# EasyEDA Pro project ProPrj_Avaota A1 八核 AIoT 开发板_2024-05-20.epro, board PCB1 (continued)
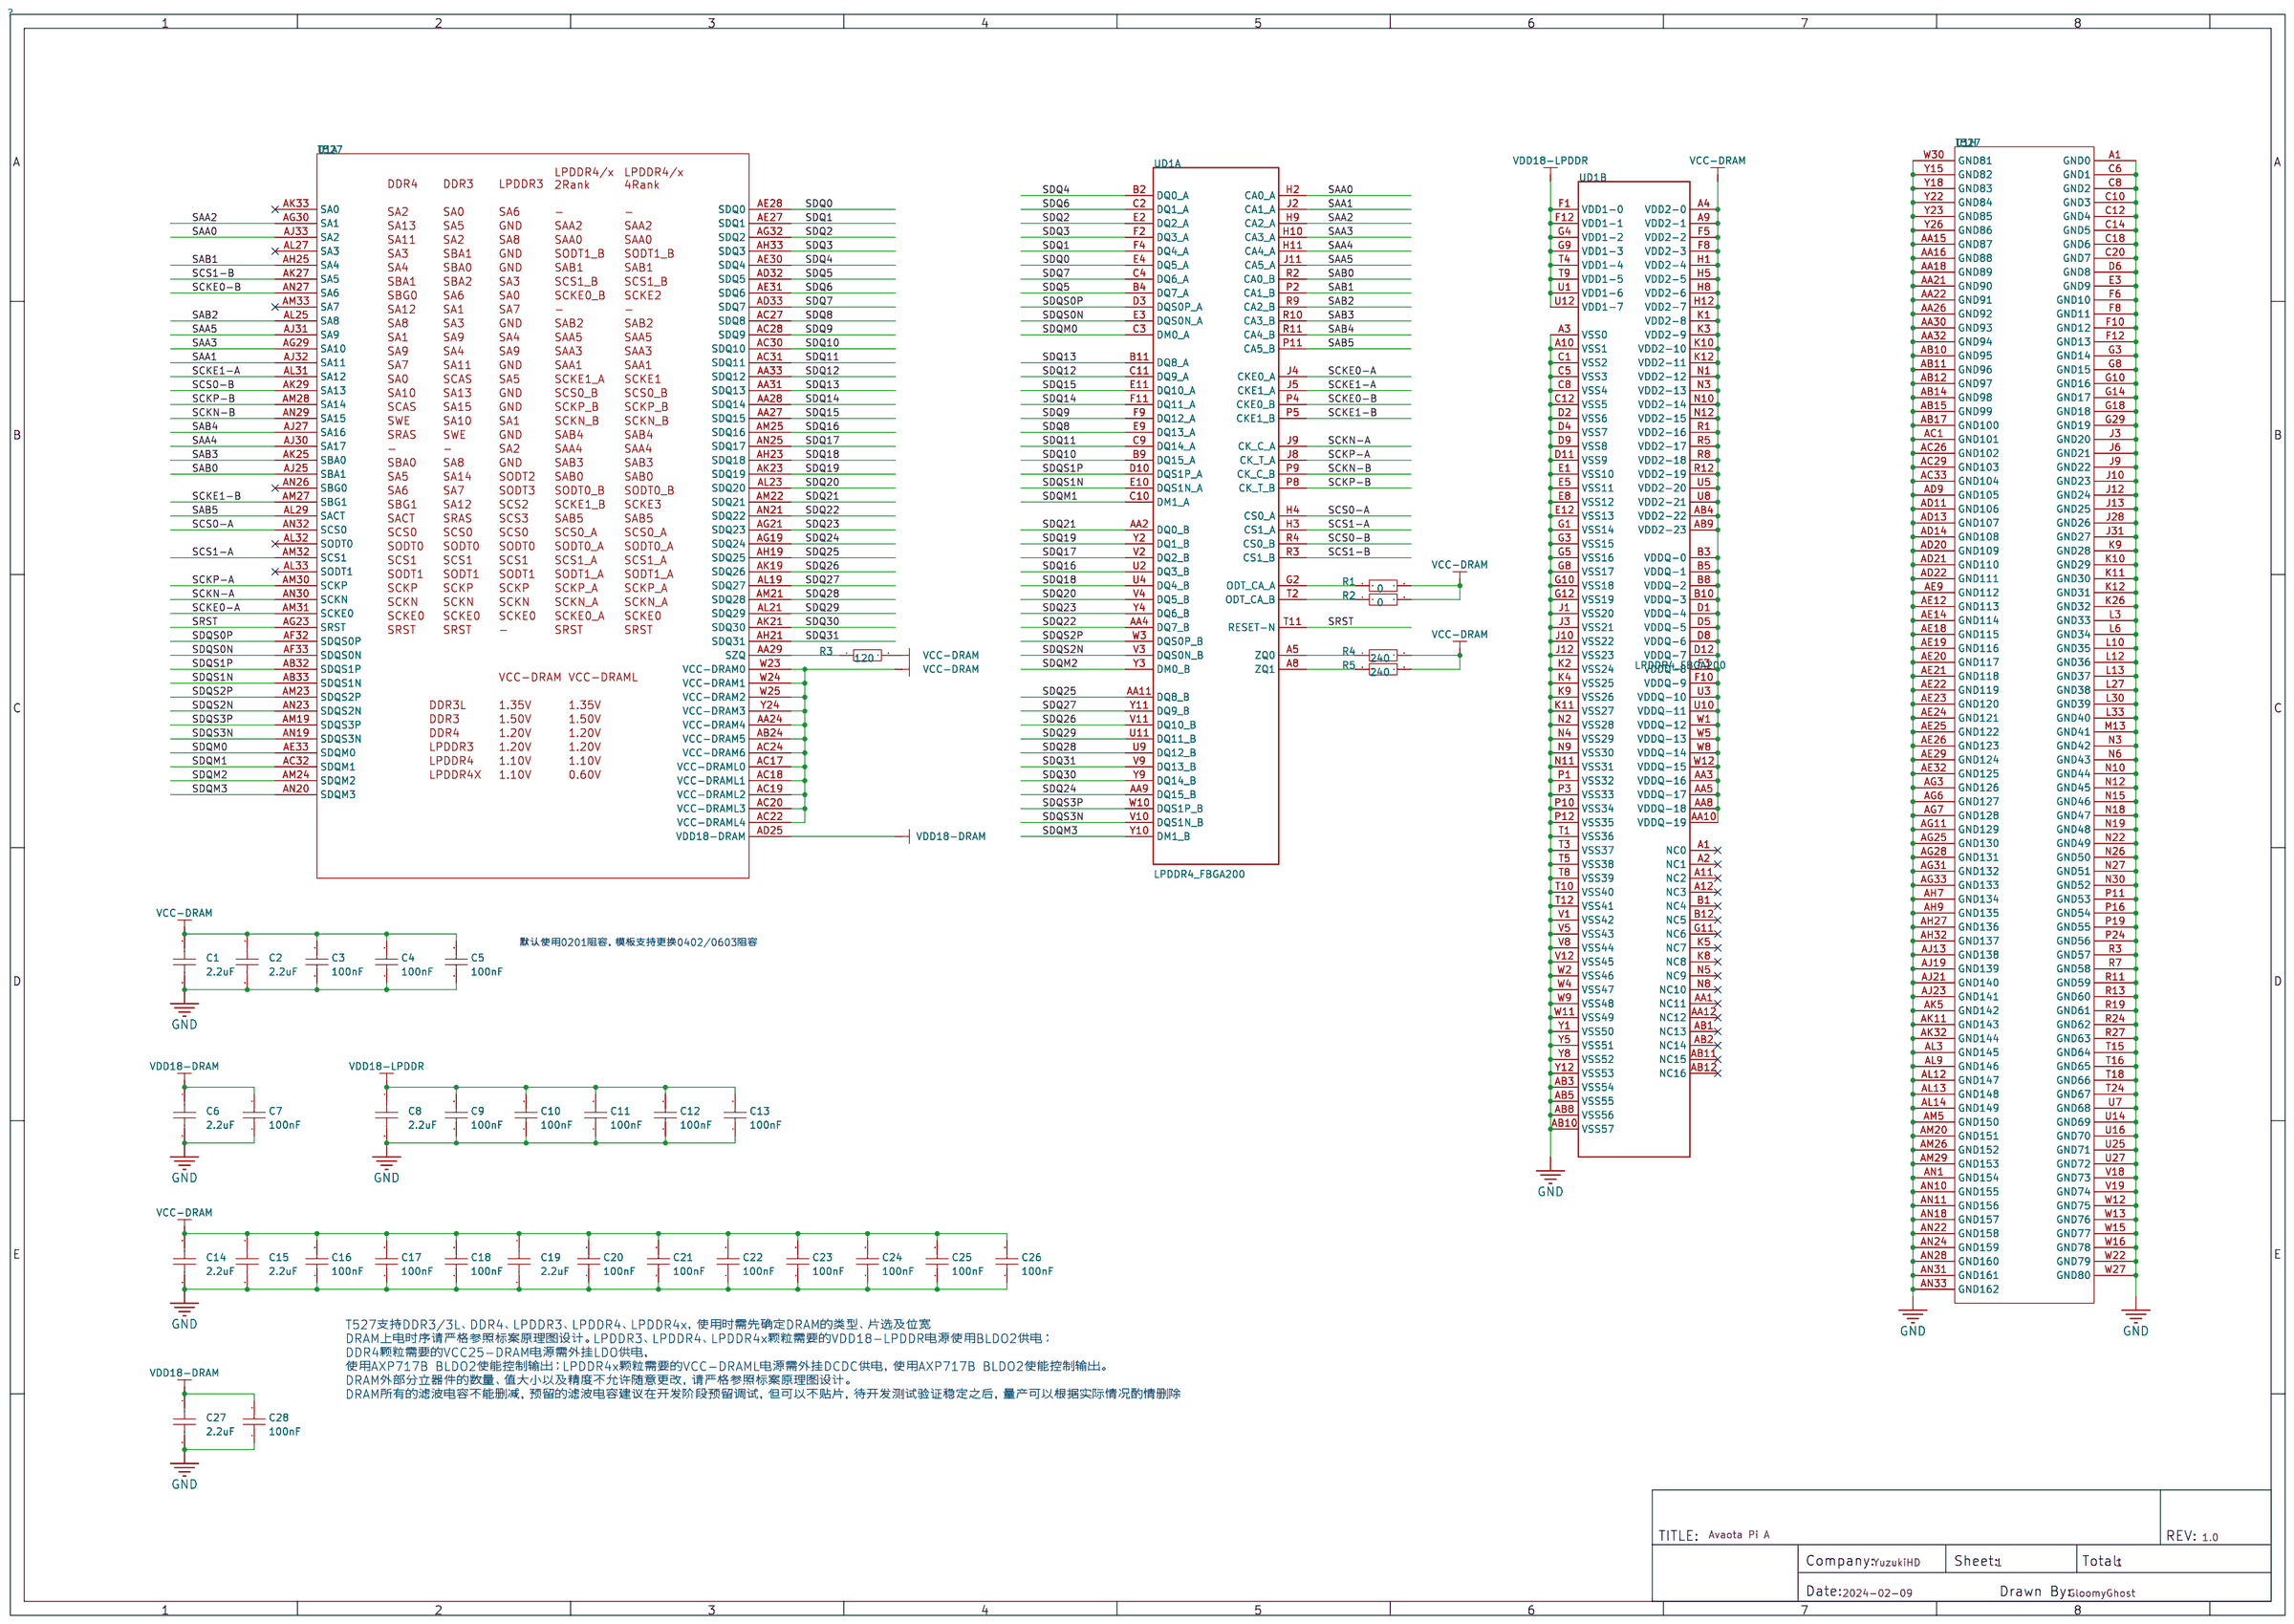
[diagram p0: schematic sheet]
## Routing (per net, layer and track width the routed paths; a pad name or vN(x,y) marks a point on that pad's centre or on a via; arc(x,y) is an arc through that point) (continued)
UART1-RTS: length 57.3
  Top Layer w0.076: U9.44 17.04,66.04 17.5,65.58 17.7,65.58 18.34,64.95 18.34,62.28 17.51,61.45 17.51,61.16 17.73,60.93 18.75,60.93 v3(19.05,61.24)
  Top Layer w0.102: v3(62.95,54.65) U14.R4
  Inner5 w0.102: v3(62.95,54.65) 62.95,54.93 62.36,55.52 61.19,55.52 58.32,58.39 56.69,58.39 55.32,59.77 49.3,59.77 45.34,63.73 21.54,63.73 v3(19.05,61.24)
UART1-RX: length 56.7
  Top Layer w0.076: U9.42 19.05,66.16 19.05,61.85 v3(18.49,61.29)
  Top Layer w0.102: v3(62.95,54.15) U14.R5
  Inner5 w0.102: v3(18.49,61.29) 21.26,64.06 45.44,64.06 49.35,60.15 55.35,60.15 56.82,58.67 58.45,58.67 61.32,55.8 62.59,55.8 63.3,55.09 63.3,54.49 v3(62.95,54.15)
UART1-TX: length 58.8
  Top Layer w0.076: v3(17.91,61.32) 18.72,62.13 18.72,65.08 17.94,65.86 U9.43
  Top Layer w0.102: U14.R6 v3(62.95,53.65)
  Inner5 w0.102: v3(17.91,61.32) 20.98,64.39 45.54,64.39 49.5,60.43 55.52,60.43 57.02,58.93 58.6,58.93 61.42,56.11 62.71,56.11 63.6,55.22 63.6,54.3 v3(62.95,53.65)
USB0-DM: length 37.7
  Top Layer w0.076: U14.B24 69.05,44.65 69.29,44.4 70.72,44.4 70.82,44.5 71.37,44.5 71.45,44.58 75.11,44.58 v3(75.23,44.45)
  Top Layer w0.127: USB3.B7 86.4,67.58 v3(86.33,67.51) ; v3(85.37,65.02) 85.55,65.2 85.55,66.28 D26.2 85.1,66.86 85.34,67.11 v3(85.34,67.49) 85.47,67.62 85.47,68.48 USB3.A7
  VCC w0.127: v3(75.23,44.45) 75.23,44.79 75.37,44.93 75.37,46.84 81.36,52.83 81.36,59.44 85.55,63.63 85.55,64.85 v3(85.37,65.02)
  Bottom Layer w0.127: v3(86.33,67.51) 86.31,67.49 v3(85.34,67.49)
USB0-DP: length 38.1
  Top Layer w0.076: U14.A24 69.66,44.65 69.7,44.6 70.61,44.6 70.69,44.68 71.17,44.68 71.33,44.84 75.43,44.84 v3(75.74,44.53)
  Top Layer w0.127: v3(85.95,65.02) 85.78,65.2 85.78,66.41 D25.2 85.83,67.27 85.83,68.48 USB3.A6 85.9,69.35 85.72,69.52 85.09,69.52 84.9,69.33 USB3.B6
  VCC w0.127: v3(75.74,44.53) 75.74,44.79 75.6,44.93 75.6,46.7 81.64,52.73 81.64,59.36 85.78,63.5 85.78,64.85 v3(85.95,65.02)
USB0-DRVVBUS: length 90
  Top Layer w0.076: 56.92,47.11 v1(56.92,46.99) 56.87,47.22 56.67,47.32 56.46,47.57 55.01,47.57 U14.AL17
  Top Layer w0.152: v1(93.32,65.13) 93.48,64.96 U17.4 94.72,64.52 R118.2
  内层2 w0.102: v1(43.56,57.63) 44.35,56.85 44.63,56.85 45.01,56.46 45.62,56.46 46.53,55.55 49.3,55.55 50.9,53.95 50.9,50.44 51.31,50.04 52.12,50.04 53.9,48.26 54.41,48.26 54.74,47.93 55.98,47.93 v1(56.92,46.99)
  内层4 w0.152: v1(42.09,64.9) 44.58,67.39 64.26,67.39 67.01,64.64 87.78,64.64 91.16,68.02 91.64,68.02 91.95,67.72 91.95,66.5 v1(93.32,65.13)
  Bottom Layer w0.102: v1(42.09,64.9) 43,63.98 43,59.11 43.69,58.42 43.69,57.76 v1(43.56,57.63)
USB0-VBUSDET: length 83.1
  Top Layer w0.076: v1(56.92,47.57) 56.67,47.83 55.26,47.83 U14.AK17
  Top Layer w0.102: R121.2 R120.1 91.5,68.22 91.36,68.08 v3(91.36,67.62)
  内层2 w0.102: v1(44.15,57.71) 44.63,57.23 44.78,57.23 45.16,56.85 45.72,56.85 46.74,55.83 49.5,55.83 51.18,54.15 51.18,50.57 51.46,50.29 52.22,50.29 53.97,48.54 54.56,48.54 54.86,48.23 56.26,48.23 v1(56.92,47.57)
  内层4 w0.152: v1(42.67,64.9) 44.7,66.93 64.01,66.93 66.7,64.24 87.99,64.24 v3(91.36,67.62)
  Bottom Layer w0.102: v1(44.15,57.71) 43.97,57.89 43.97,58.6 43.31,59.26 43.31,64.26 v1(42.67,64.9)
USB1-DM: length 99.4
  Top Layer w0.102: v3(67.44,45.15) U14.E24
  Top Layer w0.127: USB2.2 28.65,7.24 28.88,7.01 28.88,6.51 29.57,5.82 32.99,5.82 34.62,7.44 35.55,7.44 37.62,9.51 37.62,12.29 36.29,13.61 33.41,13.61 32.42,14.61 32.42,14.93 32.56,15.07 D13.7 D13.4 32.49,16.42 32.49,17.09 v3(32.54,17.15)
  Bottom Layer w0.127: v3(67.44,45.15) 67.79,44.8 68.39,44.8 69.15,44.04 69.9,44.04 71.32,42.62 71.32,35.97 66.52,31.17 47.02,31.17 44,28.14 35.03,28.14 26.71,19.82 26.71,15.96 28.11,14.55 31.85,14.55 32.41,15.11 32.41,17.02 v3(32.54,17.15)
USB1-DP: length 99.2
  Top Layer w0.102: U14.D24 v3(67.94,45.15)
  Top Layer w0.127: USB2.3 29.33,7.24 29.11,7.01 29.11,6.6 29.67,6.05 32.9,6.05 34.53,7.67 35.46,7.67 37.39,9.6 37.39,12.19 36.2,13.39 33.32,13.39 32.19,14.51 32.19,14.93 32.06,15.07 D13.6 D13.5 32.11,16.4 32.11,17.07 v3(32.03,17.15)
  Bottom Layer w0.127: v3(32.03,17.15) 32.18,16.99 32.18,16.87 32.06,16.74 31.79,16.74 31.66,16.62 31.66,16.49 31.79,16.36 32.06,16.36 32.18,16.24 32.18,16.11 32.06,15.98 31.79,15.98 31.66,15.86 31.66,15.73 31.79,15.6 32.06,15.6 32.18,15.47 32.18,15.24 31.75,14.81 28.18,14.81 26.94,16.05 26.94,19.72 35.13,27.91 44.09,27.91 47.14,30.96 66.64,30.96 71.53,35.85 71.53,42.71 69.96,44.27 69.24,44.27 68.49,45.03 68.33,45.03 68.21,45.15 v3(67.94,45.15)
USB2-DM: length 94.3
  Top Layer w0.102: U14.E22 v3(67.44,46.15)
  Top Layer w0.127: v3(27.69,18.03) 27.86,18.21 27.86,19.05 27.53,19.38 25.3,19.38 24.26,18.34 24.26,16.82 24.39,16.68 D14.4 D14.7 24.39,15.08 24.26,14.95 24.26,14.35 v3(24.41,14.2)
  Bottom Layer w0.127: v3(24.41,14.2) 24.41,13.94 24.27,13.8 24.27,13.73 24.84,13.16 25.52,13.16 26.14,12.54 26.14,11.51 26.97,10.68 26.97,10.09 27.32,9.73 28.63,9.73 28.93,10.03 28.93,10.24 28.73,10.44 USB2.11 ; v3(27.69,18.03) 27.86,18.21 27.86,19.37 28.1,19.61 28.1,19.79 28.28,19.97 28.46,19.97 28.64,20.15 28.64,20.33 28.82,20.51 29,20.51 29.18,20.69 29.18,20.87 29.36,21.05 29.54,21.05 29.72,21.23 29.72,21.41 29.9,21.59 30.08,21.59 30.26,21.77 30.26,21.95 30.44,22.13 30.62,22.13 30.8,22.31 30.8,22.49 30.98,22.67 31.16,22.67 31.34,22.85 31.34,23.03 31.52,23.21 31.7,23.21 31.88,23.39 31.88,23.57 32.06,23.75 32.24,23.75 32.41,23.92 32.41,24.1 32.59,24.28 32.77,24.28 32.95,24.46 32.95,24.64 33.13,24.82 33.31,24.82 33.49,25 33.49,25.18 33.67,25.36 33.85,25.36 34.03,25.54 34.03,25.72 34.21,25.9 34.39,25.9 35.52,27.03 44.38,27.03 47.76,30.4 75.23,30.4 76.25,31.42 76.25,32.7 74.02,34.93 74.02,37.8 71.98,39.83 71.98,42.75 70.13,44.6 69.59,44.6 68.39,45.8 67.79,45.8 v3(67.44,46.15)
USB2-DP: length 94.4
  Top Layer w0.102: U14.D22 v3(67.94,46.15)
  Top Layer w0.127: v3(28.35,18.03) 28.09,18.29 28.09,19.14 27.63,19.61 25.15,19.61 24.03,18.49 24.03,16.84 23.89,16.7 D14.6 23.89,15.08 24.03,14.95 24.03,14.32 v3(23.9,14.2)
  Bottom Layer w0.127: v3(28.35,18.03) 28.09,18.29 28.09,19.28 35.61,26.8 44.48,26.8 47.88,30.2 75.35,30.2 76.48,31.33 76.48,32.79 74.24,35.03 74.24,37.9 72.21,39.93 72.21,42.84 70.22,44.83 69.69,44.83 68.49,46.03 68.33,46.03 68.21,46.15 v3(67.94,46.15) ; v3(23.9,14.2) 23.9,13.94 24.04,13.8 24.04,13.64 24.75,12.93 25.43,12.93 25.91,12.45 25.91,11.41 26.74,10.58 26.74,9.99 27.23,9.5 28.72,9.5 29.16,9.94 29.16,10.24 29.41,10.49 29.98,10.49 USB2.12
USB2-RXN: length 84.2
  Top Layer w0.076: U14.C23 68.7,44.89 69.71,44.89 69.82,44.79 70.52,44.79 70.88,45.15 71.69,45.15 71.81,45.26 72.11,45.26 v3(72.31,45.47)
  Top Layer w0.127: v3(31.17,17.15) 31.04,17.02 31.04,16.79 31.15,16.68 D15.1 D15.10 31.15,15.08 31.01,14.95 31.01,14.55 32.16,13.41 32.16,12.24 32.46,11.94 USB2.14
  Bottom Layer w0.127: v3(72.31,45.47) 72.31,45.2 72.26,45.15 72.26,45.09 73.71,43.64 73.71,40.95 74.98,39.68 76.52,39.68 79.5,36.7 79.5,31.55 76.45,28.5 49.19,28.5 45.46,24.77 36.96,24.77 30.99,18.8 30.99,17.32 v3(31.17,17.15)
USB2-RXP: length 84.2
  Top Layer w0.076: U14.B23 69,45.09 69.77,45.09 69.9,44.95 70.38,44.95 70.76,45.34 71.55,45.34 v3(71.83,45.62)
  Top Layer w0.127: USB2.15 31.62,11.94 31.93,12.24 31.93,13.32 30.79,14.46 30.79,14.95 30.65,15.08 D15.9 D15.2 30.65,16.71 30.71,16.76 30.71,17.07 v3(30.63,17.15)
  Bottom Layer w0.127: v3(71.83,45.62) 71.83,45.23 73.48,43.58 73.48,40.85 74.89,39.45 76.43,39.45 79.27,36.6 79.27,31.65 76.35,28.73 49.1,28.73 45.36,24.99 36.86,24.99 30.78,18.92 30.78,18.3 30.66,18.17 30.33,18.17 30.2,18.04 30.2,17.92 30.33,17.79 30.66,17.79 30.78,17.66 30.78,17.3 v3(30.63,17.15)
USB2-TXN: length 76.6
  Top Layer w0.076: v3(71.3,46.05) 71.3,46 70.94,45.64 69.95,45.64 69.73,45.42 arc(69.52,45.32) 69.29,45.36 arc(69.11,45.48) 68.96,45.65
  Top Layer w0.127: C219.1 29.65,17.88 29.52,18.01 29.52,18.16 v3(29.64,18.29)
  Bottom Layer w0.127: v3(71.3,46.05) 71.3,45.76 71.16,45.62 71.16,44.84 72.87,43.13 72.87,40.46 74.57,38.76 76.24,38.76 78.56,36.44 78.56,32.11 75.74,29.29 48.44,29.29 44.81,25.66 36.3,25.66 29.49,18.85 29.49,18.44 v3(29.64,18.29)
USB2-TXP: length 76.6
  Top Layer w0.076: v3(70.79,46.03) 70.64,45.87 69.9,45.87 69.67,45.65 U14.A22
  Top Layer w0.127: C220.1 29.24,17.89 29.24,18.19 v3(29.13,18.29)
  Bottom Layer w0.127: v3(70.79,46.03) 70.79,45.76 70.93,45.62 70.93,44.74 72.64,43.03 72.64,40.37 74.48,38.53 76.15,38.53 78.33,36.35 78.33,32.21 75.67,29.54 48.37,29.54 44.72,25.89 36.2,25.89 33.67,23.36 33.39,23.36 33.26,23.23 33.26,22.95 33.13,22.82 32.85,22.82 32.72,22.69 32.72,22.41 32.59,22.28 32.31,22.28 32.18,22.15 32.18,21.87 32.05,21.74 31.77,21.74 31.64,21.61 31.64,21.33 31.51,21.2 31.23,21.2 31.1,21.07 31.1,20.79 30.97,20.66 30.7,20.66 30.57,20.53 30.57,20.25 30.44,20.12 30.16,20.12 30.03,19.99 30.03,19.72 29.9,19.59 29.62,19.59 29.49,19.46 29.49,19.18 29.26,18.95 29.26,18.42 v3(29.13,18.29)
VCM-ADC: length 0.6
  Bottom Layer w0.203: v1(59.94,52.15) 59.94,52.22 59.72,52.45 59.72,52.63 C112.2
VRA1: length 1
  Top Layer w0.152: v3(56.92,54.15) U14.AG5
  Bottom Layer w0.152: C109.2 57.36,54.15 v3(56.92,54.15)
VRA2: length 1
  Top Layer w0.152: U14.AG4 v3(56.92,54.65)
  Bottom Layer w0.152: v3(56.92,54.65) 57.42,54.65 C110.2
VREFP-ADC: length 1.3
  Bottom Layer w0.102: R24.1 59.37,52.08 v3(59.44,52.15)
  Bottom Layer w0.203: C113.2 59.44,52.19 v3(59.44,52.15)
VRP: length 1
  Bottom Layer w0.178: v3(58.44,53.15) 58.52,53.22 C111.2
WL-REG-ON: length 55.3
  Top Layer w0.076: 61.5,57.91 61.41,57.7 61.39,57.32 61.43,56.95 61.51,56.6 61.52,56.44 61.68,56.27 61.68,56 61.44,55.75 61.44,55.64
  Top Layer w0.102: v3(18.44,53.77) 18.97,53.77 20.78,51.97 27.69,51.97 34.75,59.03 54.61,59.03 56.36,60.78 61.39,60.78 62.05,60.12 62.05,58.6 61.75,58.29 61.5,57.88 ; 17.06,54.76 17.3,54.53 17.3,53.95 v3(17.48,53.77)
  Bottom Layer w0.102: v3(18.44,53.77) v3(17.48,53.77)
WL-WAKE-AP: length 53.7
  Top Layer w0.076: 61.44,56.14 61.44,56.14 61.37,56.22 61.35,56.47 61.18,56.84 61.14,57.35 61.19,57.81 61.46,58.36
  Top Layer w0.102: 61.47,58.34 61.77,58.65 61.77,59.92 61.21,60.48 56.49,60.48 54.74,58.73 34.98,58.73 27.91,51.66 20.55,51.66 18.85,53.37 18.26,53.37 17.96,53.66 17.96,54.76
X32KIN: length 7.9
  Top Layer w0.102: 50.91,52.89 R25.1 51.06,53.77 51.36,53.77 51.61,53.51 51.61,51.3 52.27,50.65 U14.AM12 ; 50.91,52.89 50.94,52.87 ; 50.91,52.89 50.66,52.89 50.4,52.63 X2.1
X32KOUT: length 8
  Top Layer w0.102: U14.AM11 53.67,50.87 52.38,50.87 51.84,51.4 51.84,53.56 51.41,53.99 51.02,53.99 R25.2 C101.2 50.62,54.91 50.35,55.18 X2.2
$1N3725: length 1.1
  Top Layer w0.152: C43.1 8.99,48.11 8.66,48.44 U4.7
$1N4703: length 2.7
  Top Layer w0.152: R13.2 4.23,55.72 4.8,55.14 5.02,55.14 5.24,54.92 6.09,54.92 U4.39
$1N4806: length 2.7
  Top Layer w0.152: R14.2 4.78,55.75 5.11,55.42 5.23,55.42 5.42,55.23 6.49,55.23 6.66,55.06 U4.38
$1N7320: length 0.8
  Top Layer w0.203: U5.8 14.2,43.01 C88.1
$1N42597: length 1.5
  Top Layer w0.152: R17.1 16.55,50.82 LED1.1
$2N1846: length 3.1
  Top Layer w0.152: R21.1 24.5,39.38 25.48,40.37 RESET1.3
$2N2360: length 4.1
  Top Layer w0.076: 60.38,57.42 60.41,56.9 60.54,56.59 60.64,56.57 60.85,56.28 60.85,55.97 60.69,55.81 60.69,55.8 60.69,55.39 60.94,55.14
  Top Layer w0.102: R19.1 60.36,57.42 60.38,57.4
$2N2431: length 3.5
  Top Layer w0.076: 60.92,55.67 61.03,55.94 61.03,55.99 61.02,56.01 61.02,56.34 60.81,56.63 60.67,57.03 60.6,57.53
  Top Layer w0.102: R20.1 60.92,58.78 60.6,58.47 60.6,57.53
$2N32401: length 1.2
  Top Layer w0.152: FEL1.3 25.28,33.31 R22.1
$2N32457: length 1.2
  Top Layer w0.152: PWR1.3 25.29,48.26 R23.1
$3N7591: length 1.3
  Top Layer w0.115: v2(59.9,42.12) 59.46,42.12 59.43,42.14
  Bottom Layer w0.152: v2(59.9,42.12) 59.58,42.12 59.41,42.29 59.41,42.53 59.38,42.56
$3N7643: length 1.4
  Top Layer w0.115: 39.01,40.3 39.01,40.28 v2(38.71,39.98)
  Bottom Layer w0.115: v2(38.71,39.98) 38.71,39.73 38.98,39.45 39.27,39.45
$3N7644: length 1.3
  Top Layer w0.115: 36.61,40.3 36.61,39.86 v2(36.52,39.78)
  Bottom Layer w0.115: 36.43,40.45 36.43,39.87 v2(36.52,39.78)
$3N7648: length 3.5
  Top Layer w0.115: 41.41,44.2 41.71,44.5 42.8,44.5 43.23,44.07 43.23,43.12 43.34,43.01 43.61,43.01
$3N7649: length 3
  Top Layer w0.115: 41.41,50.05 41.7,49.76 43.43,49.76 43.66,49.99 44.15,49.99 44.19,50.03
$4N500: length 3.3
  Top Layer w0.076: 60.11,38.45 60.17,38.74 60.17,39.6 59.99,39.77 59.99,40.63
  Top Layer w0.102: R41.2 59.53,37.72 60.11,38.29 60.11,38.47
$4N609: length 4.5
  Top Layer w0.076: R42.1 72.48,47.09 71.75,47.09 71.62,47.22 70.76,47.22 70.44,46.89 68.69,46.89 68.44,47.14
$4N713: length 3
  Top Layer w0.076: 62.46,57.52 62.46,57.5 62.52,56.91 62.54,56.87 62.46,56.17 62.44,56.14 ; 62.46,57.48 62.46,57.48
  Top Layer w0.102: R43.1 62.99,58.45 62.46,57.91 62.46,57.48
$5N3909: length 3.5
  Top Layer w0.076: R123.2 65.33,57.34 65.03,57.04 65.03,55.74 64.94,55.64
$6N1044: length 1
  Top Layer w0.102: U14.G22 v3(66.44,46.15)
  Bottom Layer w0.152: v3(66.44,46.15) 66.44,45.69 R44.2
$6N1104: length 1
  Top Layer w0.102: v3(66.44,45.15) U14.G24
  Bottom Layer w0.152: v3(66.44,45.15) 66.43,45.14 R46.2
$6N1424: length 1.1
  Top Layer w0.102: U14.F28 v3(66.94,43.15)
  Bottom Layer w0.254: R55.2 66.62,43.47 v3(66.94,43.15)
$6N1887: length 3.3
  Top Layer w0.102: U14.G20 v3(66.44,47.18)
  Bottom Layer w0.102: R45.1 68.33,47.35 68.12,47.55 67.26,47.55 66.89,47.18 v3(66.44,47.18)
$6N1980: length 2.5
  Top Layer w0.102: U14.E20 v3(67.44,47.18)
  Bottom Layer w0.102: R49.2 68.8,46.56 68.17,46.56 67.97,46.76 67.72,46.76 67.44,47.04 v3(67.44,47.18)
$6N3848: length 0.9
  Top Layer w0.127: R47.2 D7.2
$6N3980: length 12.6
  Top Layer w0.102: v3(41.61,18.82) 41.61,19.02 40.71,19.92 D8.1
  Top Layer w0.127: D8.1 D8.10 40.71,21.84 R48.2
  Bottom Layer w0.102: 43.54,12.94 44.27,13.67 44.27,14.4 44.83,14.96 44.83,16.79 42.52,19.1 41.88,19.1 v3(41.61,18.82)
$6N4130: length 7
  Top Layer w0.508: USB1.18 40.74,15.83 40.41,16.15 40.18,16.15 39.5,16.84 39.5,17.48 39.57,17.55 D9.1
$6N4341: length 10.6
  Top Layer w0.102: v3(42.09,18.69) 42.09,19 41.21,19.88 D8.2
  Top Layer w0.127: D8.2 D8.9 41.21,21.93 ; 41.21,21.93 41.21,21.94 R52.2 ; 41.21,21.93 R50.2
  Bottom Layer w0.102: v3(42.09,18.69) 42.44,18.69 44.53,16.61 44.53,15.08 USB1.15
$6N4352: length 8.5
  Top Layer w0.102: D8.4 42.21,19.95 42.47,19.69 42.47,17.07 42.63,16.91 arc(42.69,16.79) 42.72,16.66 arc(42.77,16.48) 42.88,16.33 arc(43.02,16.16) 43.13,15.98 arc(43.16,15.82) 43.13,15.67 arc(43.06,15.55) 42.98,15.44 arc(42.72,15.08) USB1.16
  Top Layer w0.127: 42.21,22.02 R51.2 ; 42.21,22.02 D8.7 D8.4 ; 42.21,22.02 42.4,22.21 R53.2
$6N4414: length 6.3
  Top Layer w0.102: USB1.19 42.71,17.24 D8.5
  Top Layer w0.127: R54.2 42.71,21.84 D8.6 D8.5
$6N5317: length 19.1
  Top Layer w0.127: 56.86,22.59 56.72,22.46 56.72,22.39 57.63,21.48 57.63,11.74 54.66,8.77 54.66,8.4 53.93,7.68 53.89,7.68 ; C190.2 56.84,23.9 D10.1 ; 56.88,22.6 56.88,23.88
$6N5400: length 18.1
  Top Layer w0.127: 56.36,23 56.36,22.59 56.49,22.46 56.49,22.3 57.4,21.39 57.4,11.81 54.57,8.98 53.89,8.98 ; C191.2 56.36,24.76 D10.2 D10.9
$6N5519: length 19.9
  Top Layer w0.127: 55.36,23 55.36,22.59 55.22,22.46 55.22,22.39 56.69,20.92 56.69,12.32 56.59,12.22 56.59,11.87 56.5,11.77 56.15,11.77 56.06,11.68 56.06,11.33 55.96,11.24 55.61,11.24 55.52,11.14 55.52,10.79 55.43,10.7 55.07,10.7 54.94,10.57 54.94,10.29 54.25,9.6 53.66,9.6 52.39,8.33 ; D10.7 D10.4 55.36,24.75 C192.2
$6N5561: length 19.8
  Top Layer w0.127: 52.39,9.63 52.39,9.18 52.5,9.06 52.73,9.06 53.16,9.5 53.16,10.51 53.53,10.88 54.19,10.88 54.45,10.62 54.63,10.62 56.46,12.45 56.46,20.83 54.99,22.3 54.99,22.46 54.86,22.59 54.86,23 ; C193.2 54.86,24.76 D10.5 D10.6
$6N5603: length 14.8
  Top Layer w0.127: D11.10 D11.1 54,24.76 C194.2 ; 54,23.01 54,22.6 53.87,22.47 53.87,22.4 54.79,21.48 54.79,18.39 55.42,17.75 55.42,12.75 54.88,12.21 54.48,12.21 53.89,11.62 53.89,11.58
$6N5645: length 14.3
  Top Layer w0.127: C195.2 53.5,24.76 D11.2 D11.9 ; 53.89,12.88 54.05,12.88 54.48,12.44 54.79,12.44 55.19,12.85 55.19,17.66 54.56,18.29 54.56,21.39 53.64,22.31 53.64,22.47 53.5,22.6 53.5,23.01
$6N5687: length 20.3
  Top Layer w0.127: 52.5,23.01 52.5,22.6 52.37,22.47 52.37,21.66 52.04,21.33 50.89,21.33 49.43,19.87 49.43,12.75 50.34,11.83 50.5,11.83 50.62,11.96 50.62,12.54 50.75,12.67 50.88,12.67 51,12.54 51,11.96 51.13,11.83 51.26,11.83 51.38,11.96 51.38,12.54 51.51,12.67 51.64,12.67 51.77,12.54 51.77,11.96 51.89,11.83 52.17,11.83 52.39,12.05 52.39,12.23 ; D11.7 D11.4 52.5,24.75 C196.2
$6N5729: length 20.4
  Top Layer w0.127: D11.6 D11.5 52,24.76 C197.2 ; 52,23.01 52,22.6 52.14,22.47 52.14,21.76 51.94,21.56 50.8,21.56 49.2,19.96 49.2,12.6 50.22,11.58 52.73,11.58 53.06,11.91 53.06,12.57 52.39,13.24 52.39,13.53
$6N6451: length 14.7
  Top Layer w0.127: R61.2 49.69,24.8 C199.2 49.64,24.75 D12.2 49.64,22.6 49.5,22.47 49.5,21.6 49.68,21.42 v3(49.68,21.41)
  Bottom Layer w0.127: v3(49.68,21.41) 49.68,21.15 49.53,21 49.53,16.69 50.29,15.93 51.51,15.93 51.66,16.08 51.66,16.51 51.94,16.79 52.76,16.79 53.89,17.92 U15.17
$6N6466: length 14.6
  Top Layer w0.127: v3(49.15,21.41) 49.15,21.48 49.28,21.6 49.28,22.47 49.14,22.6 D12.1 49.14,24.75 C198.2 49.09,24.8 R62.2
  Bottom Layer w0.127: v3(49.15,21.41) 49.15,21.15 49.28,21.02 49.28,16.62 50.2,15.7 51.56,15.7 51.79,15.47 52.7,15.47 53.89,16.65 53.89,16.78
$6N6553: length 1.2
  Bottom Layer w0.102: R57.2 52.38,14.82 52.39,14.83
$6N6556: length 3.4
  Bottom Layer w0.102: U15.13 53.89,15.3 52.78,14.2 51.26,14.2 R56.2
$6N19248: length 8.5
  Top Layer w0.127: USB2.18 25.65,11.94 25.91,12.19 25.91,12.85 27.03,13.97 28.73,13.97 29.28,14.53 29.28,14.95 29.15,15.08 D15.6 29.15,17.17 C220.2
$6N19249: length 8.5
  Top Layer w0.127: USB2.17 26.39,11.94 26.14,12.19 26.14,12.76 27.12,13.74 28.82,13.74 29.51,14.43 29.51,14.95 29.65,15.08 D15.7 D15.4 29.65,17.2
$6N30377: length 1.2
  Top Layer w0.152: R117.1 91.57,64.56 U17.3
$8N2040: length 3.5
  Bottom Layer w0.102: 90.68,50.83 91.4,50.83 D16.1 92.81,52.05 92.81,52.88
$8N6741: length 2.6
  Top Layer w0.254: LED2.1 4.45,17.02 LED3.3
$8N6795: length 2.6
  Top Layer w0.254: LED3.1 2.62,12.26 LED4.3
$8N6805: length 2.6
  Top Layer w0.254: LED4.1 4.45,11.12 LED5.3
$8N9148: length 1.8
  Bottom Layer w0.102: 86.82,47.76 86.79,47.73 R116.1 R115.2
$8N11462: length 6.4
  Top Layer w0.254: 87.28,42.38 87.28,44.23 88.57,45.52 v1(90.02,45.52)
  Bottom Layer w0.254: R126.1 88.77,45.52 v1(90.02,45.52)
$10N1043: length 3.1
  Bottom Layer w0.508: C248.2 60.56,16.15 RJ1.P1
$10N3488: length 7.9
  Top Layer w0.152: RJ1.12 61.8,2.82 59.08,2.82 57.56,4.34 57.56,5.25 R79.2
$10N3497: length 15.6
  Top Layer w0.152: RJ1.13 70.21,2.54 62.51,2.54 61.95,3.1 59.23,3.1 57.86,4.47 57.86,5.23 57.99,5.36 R80.1
$11N1789: length 3.3
  Bottom Layer w0.508: C255.2 78.85,16.1 RJ2.P1
$11N1876: length 8
  Top Layer w0.152: RJ2.12 80.32,2.54 77.06,2.54 76.12,3.48 76.12,5.03 75.96,5.2 R97.2
$11N1882: length 15.8
  Top Layer w0.152: 89.51,1.48 88.35,2.64 80.82,2.64 80.52,2.95 77.04,2.95 76.4,3.58 76.4,5.03 76.56,5.19 R98.1
$12N673: length 3.6
  Top Layer w0.254: 20.62,22.27 20.62,22.28 R1.1 19.36,21.9 Q1.1
$12N750: length 4.9
  Top Layer w0.254: DC1.5 7.67,6.26 C3.2
$12N1163: length 3.8
  Top Layer w0.254: U3.1 10.72,29.74 10.59,29.62 9.42,29.62 8.53,28.73 C4.1
$12N1491: length 1.6
  Top Layer w0.508: U3.4 14.9,30.39 C8.2
$12N1559: length 2.7
  Top Layer w0.254: C4.2 8.56,29.62 8.56,30.27 D4.2
$12N1618: length 3.7
  Top Layer w0.254: U3.6 13.26,36.78 12.5,37.54 12.14,37.54 11.58,38.1 C9.1 C10.1
$12N1697: length 0.9
  Top Layer w0.254: C9.2 11.56,39.95 R7.1
$12N1966: length 0.9
  Top Layer w0.254: R3.1 13.43,38.13 R5.2
$12N2016: length 4.4
  Top Layer w0.254: U3.5 14.53,37.31 14.27,37.57 12.98,37.57 R5.1 12.47,39.07
$12N2052: length 4.3
  Top Layer w0.254: R4.1 15.27,28.35 R6.2 13.52,29.33 13.28,29.57 13.28,30.73 U3.3
$12N3300: length 2
  Top Layer w0.508: 18.21,31.11 18.21,31.72 D1.1
$13N975: length 1.7
  Top Layer w0.127: RF1.1 9.91,64.17 C245.2 R72.2
$13N1231: length 1.3
  Bottom Layer w0.102: U11.8 95.02,18.59 94.56,19.05 94.27,19.05 R76.1
$13N1378: length 0.5
  Top Layer w0.254: 94.47,20.21 94.47,20.21 R77.1
$13N1478: length 6.7
  Top Layer w0.254: v1(96.27,21.03) 95.4,21.9 CN3.1 94.77,21.9 93.96,21.09 R77.2
  Bottom Layer w0.254: 96.29,18.32 96.29,18.87 97,19.58 97,20.29 v1(96.27,21.03)
$13N1485: length 9.5
  Top Layer w0.254: R78.2 94.88,21.11 95.35,21.11 95.88,20.57 96.52,20.57 96.8,20.85 v1(96.8,21.34) 96.77,21.34 96.27,21.84 96.27,22.45 95.56,23.16 CN3.2
  Bottom Layer w0.254: v1(96.8,21.34) 97.56,20.57 U11.6
$13N1600: length 0.5
  Bottom Layer w0.127: 70.49,69.09 70.49,68.58 70.5,68.57
$13N1603: length 0.5
  Bottom Layer w0.127: R66.1 C241.2
$13N2020: length 0.7
  Bottom Layer w0.254: R67.2 67.02,68.57 67.12,68.68
$13N2077: length 0.7
  Bottom Layer w0.254: R68.2 67.02,69.66 C243.2
$13N5258: length 1
  Top Layer w0.254: CGQ1.4 95.5,16.66 R125.1

## Copper pours and planes (outline as drawn; the poured copper is in the pictures)
GND on Top Layer: -8.84,81.31 106.93,81.31 106.93,-10.13 -8.84,-10.13
GND on Top Layer: 52.02,57.35 70.54,57.35 70.54,38.89 52.02,38.89
GND on Bottom Layer: -7.04,79.76 108.74,79.76 108.74,-11.68 -7.04,-11.68
GND on GND1: 60.53,45.47 59.1,45.47 58.8,45.77 58.8,48.21 57.99,49.02 51.81,49.02 45.36,55.47 32.43,55.47 31.93,54.97 31.93,39.5 34.87,36.55 59.15,36.55 60.81,38.2 60.81,45.19
GND on GND1: -8.17,81.08 107.6,81.08 107.6,-10.36 -8.17,-10.36
GND on GND1: 60.53,45.49 59.1,45.49 58.8,45.8 58.8,48.24 57.98,49.05 51.81,49.05 45.36,55.5 32.43,55.5 31.92,54.99 31.92,39.52 34.87,36.58 59.15,36.58 60.8,38.23 60.8,45.21
GND on 内层2: -7.99,80.77 107.79,80.77 107.79,-10.67 -7.99,-10.67
GND on VCC: -7.85,80.62 107.92,80.62 107.92,-10.82 -7.85,-10.82
GND on VCC: 60.54,45.48 59.12,45.48 58.81,45.78 58.81,48.22 58,49.03 51.83,49.03 45.38,55.49 32.45,55.49 31.94,54.98 31.94,39.51 34.88,36.56 59.17,36.56 60.82,38.21 60.82,45.2
GND on 内层4: -7.65,80.39 108.13,80.39 108.13,-11.05 -7.65,-11.05
GND on Inner5: -7.48,80.2 108.29,80.2 108.29,-11.24 -7.48,-11.24
GND on GND2: -7.29,80.01 108.48,80.01 108.48,-11.43 -7.29,-11.43
GND on GND2: 60.51,45.48 59.09,45.48 58.79,45.78 58.79,48.22 57.97,49.03 51.8,49.03 45.35,55.49 32.42,55.49 31.91,54.98 31.91,39.51 34.86,36.56 59.14,36.56 60.79,38.21 60.79,45.2
VBUS on Top Layer: 3.45,49.23 13.41,49.23 13.41,42.39 3.45,42.39
VBUS on Top Layer: 3.96,50.6 6.02,50.6 6.02,48.36 3.96,48.36
323-DCDC1/2 on Top Layer: 20.45,45.29 22.86,45.29 22.86,40.67 20.45,40.67
323-DCDC1/2 on 内层2: 59.33,48.43 59.33,45.81 59.95,45.19 62.33,45.19 62.69,45.54 62.69,50.4 52.53,60.55 32.16,60.55 27.2,55.6 27.2,52.68 20.5,45.97 20.5,41.22 21.77,39.95 23.22,39.95 25.32,42.06 25.32,44.7 31.27,50.65 31.27,54.28 32.92,55.93 47.62,55.93 54.58,48.97 58.79,48.97
323-DCDC3 on Top Layer: 15.9,48.71 19,48.71 19,47.07 15.9,47.07
323-DCDC3 on VCC: 60.81,50.9 60.81,49.91 60.3,49.4 57.51,49.4 57.48,49.43 52.22,49.43 45.82,55.83 31.75,55.83 22.22,46.3 18.03,46.3 16.71,47.61 16.71,49.15 18.97,51.41 21.72,51.41 30.4,60.1 47.65,60.1 55.6,52.15 59.56,52.15
BLDO2 on Bottom Layer: 43.23,38.99 44.66,40.42 44.66,53.91 43.31,55.27 33.34,55.27 32.02,53.96 32.02,40.14 33.17,38.99
DCDC1 on Top Layer: 11.15,47.96 13.39,47.96 13.39,45.82 11.15,45.82
DCDC1 on Bottom Layer: 10.85,47.95 12.75,47.95 12.75,45.75 10.85,45.75
DCDC1 on Inner5: 61.16,47.52 61.16,46.23 60.76,45.82 59.77,45.82 58.93,46.66 58.93,48.01 57.34,49.6 52.61,49.6 46.2,56.01 32.61,56.01 25.7,49.1 17.98,49.1 13.59,44.7 11.31,44.7 10.19,45.82 10.19,48.49 15.07,53.37 22.1,53.37 29.84,61.11 45.62,61.11 48.41,58.32 52.04,58.32 61.14,49.22 61.14,47.55
DCDC2 on Top Layer: 4.62,59.28 8.66,59.28 8.66,56.95 4.62,56.95
DCDC2 on 内层4: 58.52,49.57 58.52,49.61 52.04,49.61 45.54,56.11 19.99,56.11 16.81,59.28 14.5,59.28 13.87,59.92 10.44,59.92 9.22,58.7 9.22,57.53 8.79,57.1 6.02,57.1 5.36,57.76 5.36,60.45 7.67,62.76 20.43,62.76 22.82,60.38 54.08,60.38 65.23,49.23 65.81,49.23 66.12,48.92 66.12,48.01 63.73,45.62 63.09,45.62 62.81,45.9 62.28,45.9 62.03,46.15 62.03,47.21 61.77,47.47 60.62,47.47
DCDC3 on Top Layer: 10.69,59.97 13.41,59.97 13.41,55.73 10.69,55.73
DCDC3 on 内层4: 10.38,57.89 10.38,55.3 10.84,54.84 12.85,54.84 14.94,52.76 14.94,51.87 17.6,49.2 32.23,49.2 33.98,50.95 33.98,55.4 19.58,55.4 16.56,58.42 14.25,58.42 13.44,59.23 11.72,59.23
DCDC3 on 内层4: 60.52,45.45 59.1,45.45 58.79,45.76 58.79,48.2 58.29,48.7 51.94,48.7 45.23,55.41 32.38,55.41 31.92,54.95 31.92,39.48 34.87,36.54 59.15,36.54 60.8,38.19 60.8,45.17
DCDC4 on Bottom Layer: 3.28,54.13 5.92,54.13 5.92,52.76 3.28,52.76
DCDC4 on VCC: 2.69,54.23 4.79,54.23 4.79,52.22 2.69,52.22
DCIN-5V on Top Layer: 3.81,44.54 8.41,44.54 8.41,38.46 3.81,38.46
DCIN-12V on Top Layer: 9.27,31.93 12.7,31.93 12.7,21.59 9.27,21.59
DCIN-12V on Top Layer: 4.95,23.34 17.83,23.34 17.83,19.84 4.95,19.84
DCIN-12V on Top Layer: 17.09,25.35 17.93,25.35 17.93,21.86 17.09,21.86
GM0_DVDD10 on Top Layer: 61.45,27.48 63.04,27.48 63.04,25.76 61.45,25.76
GM0_REGOUT on Top Layer: 63.7,27.48 64.92,27.48 64.92,24.51 63.7,24.51
GM1_DVDD10 on Top Layer: 79.61,27.33 81.2,27.33 81.2,25.6 79.61,25.6
GM1_REGOUT on Top Layer: 81.86,27.32 83.09,27.32 83.09,24.35 81.86,24.35
